# EAGLE schematic Resistor_Resistor (EAGLE 8.3.0), part 30 of 43
## Nets (continued)
N$21: R3001.2 R3002.2 R3003.2 R3004.2 R3005.2 R3006.2 R3007.2 R3008.2 R3009.2 R3010.2 R3011.2 R3012.2 R3013.2 R3014.2 R3015.2 R3016.2 R3017.2 R3018.2 R3019.2 R3020.2 R3021.2 R3022.2 R3023.2 R3024.2 R3025.2 R3026.2 R3027.2 R3028.2 R3029.2 R3030.2 R3031.2 R3032.2 R3033.2 R3034.2 R3035.2 R3036.2 R3037.2 R3038.2 R3039.2 R3040.2 R3041.2 R3042.2 R3043.2 R3044.2 R3045.2 R3046.2 R3047.2 R3048.2 R3049.2 R3050.2 R3051.2 R3052.2 R3053.2 R3054.2 R3055.2 R3056.2 R3057.2 R3058.2 R3059.2 R3060.2 R3061.2 R3062.2 R3063.2 R3064.2 R3065.2 R3066.2 R3067.2 R3068.2 R3069.2 R3070.2 R3071.2 R3072.2 R3073.2 R3074.2 R3075.2 R3076.2 R3077.2 R3078.2 R3079.2 R3080.2 R3081.2 R3082.2 R3083.2 R3084.2 R3085.2 R3086.2 R3087.2 R3088.2 R3089.2 R3090.2 R3091.2 R3092.2 R3093.2 R3094.2 R3095.2 R3096.2 R3097.2 R3098.2 R3099.2 R3100.2 R3101.2 R3102.2 R3103.2 R3104.2 R3105.2 R3106.2 R3107.2 R3108.2 R3109.2 R3110.2 R3111.2 R3112.2 R3113.2 R3114.2 R3115.2 R3116.2 R3117.2 R3118.2 R3119.2 R3120.2 R3121.2 R3122.2 R3123.2 R3124.2 R3125.2 R3126.2 R3127.2 R3128.2 R3129.2 R3130.2 R3131.2 R3132.2 R3133.2 R3134.2 R3135.2 R3136.2 R3137.2 R3138.2 R3139.2 R3140.2 R3141.2 R3142.2 R3143.2 R3144.2 R3145.2 R3146.2 R3147.2 R3148.2 R3149.2 R3150.2 R3151.2 R3152.2 R3153.2 R3154.2 R3155.2 R3156.2 R3157.2 R3158.2 R3159.2 R3160.2 R3161.2 R3162.2 R3163.2 R3164.2 R3165.2 R3166.2 R3167.2 R3168.2 R3169.2 R3170.2 R3171.2 R3172.2 R3173.2 R3174.2 R3175.2 R3176.2 R3177.2 R3178.2 R3179.2 R3180.2 R3181.2 R3182.2 R3183.2 R3184.2 R3185.2 R3186.2 R3187.2 R3188.2 R3189.2 R3190.2 R3191.2 R3192.2 R3193.2 R3194.2 R3195.2 R3196.2 R3197.2 R3198.2 R3199.2 R3200.2 R3201.1 R3202.1 R3203.1 R3204.1 R3205.1 R3206.1 R3207.1 R3208.1 R3209.1 R3210.1 R3211.1 R3212.1 R3213.1 R3214.1 R3215.1 R3216.1 R3217.1 R3218.1 R3219.1 R3220.1 R3221.1 R3222.1 R3223.1 R3224.1 R3225.1 R3226.1 R3227.1 R3228.1 R3229.1 R3230.1 R3231.1 R3232.1 R3233.1 R3234.1 R3235.1 R3236.1 R3237.1 R3238.1 R3239.1 R3240.1 R3241.1 R3242.1 R3243.1 R3244.1 R3245.1 R3246.1 R3247.1 R3248.1 R3249.1 R3250.1 R3251.1 R3252.1 R3253.1 R3254.1 R3255.1 R3256.1 R3257.1 R3258.1 R3259.1 R3260.1 R3261.1 R3262.1 R3263.1 R3264.1 R3265.1 R3266.1 R3267.1 R3268.1 R3269.1 R3270.1 R3271.1 R3272.1 R3273.1 R3274.1 R3275.1 R3276.1 R3277.1 R3278.1 R3279.1 R3280.1 R3281.1 R3282.1 R3283.1 R3284.1 R3285.1 R3286.1 R3287.1 R3288.1 R3289.1 R3290.1 R3291.1 R3292.1 R3293.1 R3294.1 R3295.1 R3296.1 R3297.1 R3298.1 R3299.1 R3300.1 R3301.1 R3302.1 R3303.1 R3304.1 R3305.1 R3306.1 R3307.1 R3308.1 R3309.1 R3310.1 R3311.1 R3312.1 R3313.1 R3314.1 R3315.1 R3316.1 R3317.1 R3318.1 R3319.1 R3320.1 R3321.1 R3322.1 R3323.1 R3324.1 R3325.1 R3326.1 R3327.1 R3328.1 R3329.1 R3330.1 R3331.1 R3332.1 R3333.1 R3334.1 R3335.1 R3336.1 R3337.1 R3338.1 R3339.1 R3340.1 R3341.1 R3342.1 R3343.1 R3344.1 R3345.1 R3346.1 R3347.1 R3348.1 R3349.1 R3350.1 R3351.1 R3352.1 R3353.1 R3354.1 R3355.1 R3356.1 R3357.1 R3358.1 R3359.1 R3360.1 R3361.1 R3362.1 R3363.1 R3364.1 R3365.1 R3366.1 R3367.1 R3368.1 R3369.1 R3370.1 R3371.1 R3372.1 R3373.1 R3374.1 R3375.1 R3376.1 R3377.1 R3378.1 R3379.1 R3380.1 R3381.1 R3382.1 R3383.1 R3384.1 R3385.1 R3386.1 R3387.1 R3388.1 R3389.1 R3390.1 R3391.1 R3392.1 R3393.1 R3394.1 R3395.1 R3396.1 R3397.1 R3398.1 R3399.1 R3400.1
N$23: R3201.2 R3202.2 R3203.2 R3204.2 R3205.2 R3206.2 R3207.2 R3208.2 R3209.2 R3210.2 R3211.2 R3212.2 R3213.2 R3214.2 R3215.2 R3216.2 R3217.2 R3218.2 R3219.2 R3220.2 R3221.2 R3222.2 R3223.2 R3224.2 R3225.2 R3226.2 R3227.2 R3228.2 R3229.2 R3230.2 R3231.2 R3232.2 R3233.2 R3234.2 R3235.2 R3236.2 R3237.2 R3238.2 R3239.2 R3240.2 R3241.2 R3242.2 R3243.2 R3244.2 R3245.2 R3246.2 R3247.2 R3248.2 R3249.2 R3250.2 R3251.2 R3252.2 R3253.2 R3254.2 R3255.2 R3256.2 R3257.2 R3258.2 R3259.2 R3260.2 R3261.2 R3262.2 R3263.2 R3264.2 R3265.2 R3266.2 R3267.2 R3268.2 R3269.2 R3270.2 R3271.2 R3272.2 R3273.2 R3274.2 R3275.2 R3276.2 R3277.2 R3278.2 R3279.2 R3280.2 R3281.2 R3282.2 R3283.2 R3284.2 R3285.2 R3286.2 R3287.2 R3288.2 R3289.2 R3290.2 R3291.2 R3292.2 R3293.2 R3294.2 R3295.2 R3296.2 R3297.2 R3298.2 R3299.2 R3300.2 R3301.2 R3302.2 R3303.2 R3304.2 R3305.2 R3306.2 R3307.2 R3308.2 R3309.2 R3310.2 R3311.2 R3312.2 R3313.2 R3314.2 R3315.2 R3316.2 R3317.2 R3318.2 R3319.2 R3320.2 R3321.2 R3322.2 R3323.2 R3324.2 R3325.2 R3326.2 R3327.2 R3328.2 R3329.2 R3330.2 R3331.2 R3332.2 R3333.2 R3334.2 R3335.2 R3336.2 R3337.2 R3338.2 R3339.2 R3340.2 R3341.2 R3342.2 R3343.2 R3344.2 R3345.2 R3346.2 R3347.2 R3348.2 R3349.2 R3350.2 R3351.2 R3352.2 R3353.2 R3354.2 R3355.2 R3356.2 R3357.2 R3358.2 R3359.2 R3360.2 R3361.2 R3362.2 R3363.2 R3364.2 R3365.2 R3366.2 R3367.2 R3368.2 R3369.2 R3370.2 R3371.2 R3372.2 R3373.2 R3374.2 R3375.2 R3376.2 R3377.2 R3378.2 R3379.2 R3380.2 R3381.2 R3382.2 R3383.2 R3384.2 R3385.2 R3386.2 R3387.2 R3388.2 R3389.2 R3390.2 R3391.2 R3392.2 R3393.2 R3394.2 R3395.2 R3396.2 R3397.2 R3398.2 R3399.2 R3400.2 R3401.1 R3402.1 R3403.1 R3404.1 R3405.1 R3406.1 R3407.1 R3408.1 R3409.1 R3410.1 R3411.1 R3412.1 R3413.1 R3414.1 R3415.1 R3416.1 R3417.1 R3418.1 R3419.1 R3420.1 R3421.1 R3422.1 R3423.1 R3424.1 R3425.1 R3426.1 R3427.1 R3428.1 R3429.1 R3430.1 R3431.1 R3432.1 R3433.1 R3434.1 R3435.1 R3436.1 R3437.1 R3438.1 R3439.1 R3440.1 R3441.1 R3442.1 R3443.1 R3444.1 R3445.1 R3446.1 R3447.1 R3448.1 R3449.1 R3450.1 R3451.1 R3452.1 R3453.1 R3454.1 R3455.1 R3456.1 R3457.1 R3458.1 R3459.1 R3460.1 R3461.1 R3462.1 R3463.1 R3464.1 R3465.1 R3466.1 R3467.1 R3468.1 R3469.1 R3470.1 R3471.1 R3472.1 R3473.1 R3474.1 R3475.1 R3476.1 R3477.1 R3478.1 R3479.1 R3480.1 R3481.1 R3482.1 R3483.1 R3484.1 R3485.1 R3486.1 R3487.1 R3488.1 R3489.1 R3490.1 R3491.1 R3492.1 R3493.1 R3494.1 R3495.1 R3496.1 R3497.1 R3498.1 R3499.1 R3500.1 R3501.1 R3502.1 R3503.1 R3504.1 R3505.1 R3506.1 R3507.1 R3508.1 R3509.1 R3510.1 R3511.1 R3512.1 R3513.1 R3514.1 R3515.1 R3516.1 R3517.1 R3518.1 R3519.1 R3520.1 R3521.1 R3522.1 R3523.1 R3524.1 R3525.1 R3526.1 R3527.1 R3528.1 R3529.1 R3530.1 R3531.1 R3532.1 R3533.1 R3534.1 R3535.1 R3536.1 R3537.1 R3538.1 R3539.1 R3540.1 R3541.1 R3542.1 R3543.1 R3544.1 R3545.1 R3546.1 R3547.1 R3548.1 R3549.1 R3550.1 R3551.1 R3552.1 R3553.1 R3554.1 R3555.1 R3556.1 R3557.1 R3558.1 R3559.1 R3560.1 R3561.1 R3562.1 R3563.1 R3564.1 R3565.1 R3566.1 R3567.1 R3568.1 R3569.1 R3570.1 R3571.1 R3572.1 R3573.1 R3574.1 R3575.1 R3576.1 R3577.1 R3578.1 R3579.1 R3580.1 R3581.1 R3582.1 R3583.1 R3584.1 R3585.1 R3586.1 R3587.1 R3588.1 R3589.1 R3590.1 R3591.1 R3592.1 R3593.1 R3594.1 R3595.1 R3596.1 R3597.1 R3598.1 R3599.1 R3600.1
N$24: R3401.2 R3402.2 R3403.2 R3404.2 R3405.2 R3406.2 R3407.2 R3408.2 R3409.2 R3410.2 R3411.2 R3412.2 R3413.2 R3414.2 R3415.2 R3416.2 R3417.2 R3418.2 R3419.2 R3420.2 R3421.2 R3422.2 R3423.2 R3424.2 R3425.2 R3426.2 R3427.2 R3428.2 R3429.2 R3430.2 R3431.2 R3432.2 R3433.2 R3434.2 R3435.2 R3436.2 R3437.2 R3438.2 R3439.2 R3440.2 R3441.2 R3442.2 R3443.2 R3444.2 R3445.2 R3446.2 R3447.2 R3448.2 R3449.2 R3450.2 R3451.2 R3452.2 R3453.2 R3454.2 R3455.2 R3456.2 R3457.2 R3458.2 R3459.2 R3460.2 R3461.2 R3462.2 R3463.2 R3464.2 R3465.2 R3466.2 R3467.2 R3468.2 R3469.2 R3470.2 R3471.2 R3472.2 R3473.2 R3474.2 R3475.2 R3476.2 R3477.2 R3478.2 R3479.2 R3480.2 R3481.2 R3482.2 R3483.2 R3484.2 R3485.2 R3486.2 R3487.2 R3488.2 R3489.2 R3490.2 R3491.2 R3492.2 R3493.2 R3494.2 R3495.2 R3496.2 R3497.2 R3498.2 R3499.2 R3500.2 R3501.2 R3502.2 R3503.2 R3504.2 R3505.2 R3506.2 R3507.2 R3508.2 R3509.2 R3510.2 R3511.2 R3512.2 R3513.2 R3514.2 R3515.2 R3516.2 R3517.2 R3518.2 R3519.2 R3520.2 R3521.2 R3522.2 R3523.2 R3524.2 R3525.2 R3526.2 R3527.2 R3528.2 R3529.2 R3530.2 R3531.2 R3532.2 R3533.2 R3534.2 R3535.2 R3536.2 R3537.2 R3538.2 R3539.2 R3540.2 R3541.2 R3542.2 R3543.2 R3544.2 R3545.2 R3546.2 R3547.2 R3548.2 R3549.2 R3550.2 R3551.2 R3552.2 R3553.2 R3554.2 R3555.2 R3556.2 R3557.2 R3558.2 R3559.2 R3560.2 R3561.2 R3562.2 R3563.2 R3564.2 R3565.2 R3566.2 R3567.2 R3568.2 R3569.2 R3570.2 R3571.2 R3572.2 R3573.2 R3574.2 R3575.2 R3576.2 R3577.2 R3578.2 R3579.2 R3580.2 R3581.2 R3582.2 R3583.2 R3584.2 R3585.2 R3586.2 R3587.2 R3588.2 R3589.2 R3590.2 R3591.2 R3592.2 R3593.2 R3594.2 R3595.2 R3596.2 R3597.2 R3598.2 R3599.2 R3600.2 R3601.1 R3602.1 R3603.1 R3604.1 R3605.1 R3606.1 R3607.1 R3608.1 R3609.1 R3610.1 R3611.1 R3612.1 R3613.1 R3614.1 R3615.1 R3616.1 R3617.1 R3618.1 R3619.1 R3620.1 R3621.1 R3622.1 R3623.1 R3624.1 R3625.1 R3626.1 R3627.1 R3628.1 R3629.1 R3630.1 R3631.1 R3632.1 R3633.1 R3634.1 R3635.1 R3636.1 R3637.1 R3638.1 R3639.1 R3640.1 R3641.1 R3642.1 R3643.1 R3644.1 R3645.1 R3646.1 R3647.1 R3648.1 R3649.1 R3650.1 R3651.1 R3652.1 R3653.1 R3654.1 R3655.1 R3656.1 R3657.1 R3658.1 R3659.1 R3660.1 R3661.1 R3662.1 R3663.1 R3664.1 R3665.1 R3666.1 R3667.1 R3668.1 R3669.1 R3670.1 R3671.1 R3672.1 R3673.1 R3674.1 R3675.1 R3676.1 R3677.1 R3678.1 R3679.1 R3680.1 R3681.1 R3682.1 R3683.1 R3684.1 R3685.1 R3686.1 R3687.1 R3688.1 R3689.1 R3690.1 R3691.1 R3692.1 R3693.1 R3694.1 R3695.1 R3696.1 R3697.1 R3698.1 R3699.1 R3700.1 R3701.1 R3702.1 R3703.1 R3704.1 R3705.1 R3706.1 R3707.1 R3708.1 R3709.1 R3710.1 R3711.1 R3712.1 R3713.1 R3714.1 R3715.1 R3716.1 R3717.1 R3718.1 R3719.1 R3720.1 R3721.1 R3722.1 R3723.1 R3724.1 R3725.1 R3726.1 R3727.1 R3728.1 R3729.1 R3730.1 R3731.1 R3732.1 R3733.1 R3734.1 R3735.1 R3736.1 R3737.1 R3738.1 R3739.1 R3740.1 R3741.1 R3742.1 R3743.1 R3744.1 R3745.1 R3746.1 R3747.1 R3748.1 R3749.1 R3750.1 R3751.1 R3752.1 R3753.1 R3754.1 R3755.1 R3756.1 R3757.1 R3758.1 R3759.1 R3760.1 R3761.1 R3762.1 R3763.1 R3764.1 R3765.1 R3766.1 R3767.1 R3768.1 R3769.1 R3770.1 R3771.1 R3772.1 R3773.1 R3774.1 R3775.1 R3776.1 R3777.1 R3778.1 R3779.1 R3780.1 R3781.1 R3782.1 R3783.1 R3784.1 R3785.1 R3786.1 R3787.1 R3788.1 R3789.1 R3790.1 R3791.1 R3792.1 R3793.1 R3794.1 R3795.1 R3796.1 R3797.1 R3798.1 R3799.1 R3800.1
N$25: R3601.2 R3602.2 R3603.2 R3604.2 R3605.2 R3606.2 R3607.2 R3608.2 R3609.2 R3610.2 R3611.2 R3612.2 R3613.2 R3614.2 R3615.2 R3616.2 R3617.2 R3618.2 R3619.2 R3620.2 R3621.2 R3622.2 R3623.2 R3624.2 R3625.2 R3626.2 R3627.2 R3628.2 R3629.2 R3630.2 R3631.2 R3632.2 R3633.2 R3634.2 R3635.2 R3636.2 R3637.2 R3638.2 R3639.2 R3640.2 R3641.2 R3642.2 R3643.2 R3644.2 R3645.2 R3646.2 R3647.2 R3648.2 R3649.2 R3650.2 R3651.2 R3652.2 R3653.2 R3654.2 R3655.2 R3656.2 R3657.2 R3658.2 R3659.2 R3660.2 R3661.2 R3662.2 R3663.2 R3664.2 R3665.2 R3666.2 R3667.2 R3668.2 R3669.2 R3670.2 R3671.2 R3672.2 R3673.2 R3674.2 R3675.2 R3676.2 R3677.2 R3678.2 R3679.2 R3680.2 R3681.2 R3682.2 R3683.2 R3684.2 R3685.2 R3686.2 R3687.2 R3688.2 R3689.2 R3690.2 R3691.2 R3692.2 R3693.2 R3694.2 R3695.2 R3696.2 R3697.2 R3698.2 R3699.2 R3700.2 R3701.2 R3702.2 R3703.2 R3704.2 R3705.2 R3706.2 R3707.2 R3708.2 R3709.2 R3710.2 R3711.2 R3712.2 R3713.2 R3714.2 R3715.2 R3716.2 R3717.2 R3718.2 R3719.2 R3720.2 R3721.2 R3722.2 R3723.2 R3724.2 R3725.2 R3726.2 R3727.2 R3728.2 R3729.2 R3730.2 R3731.2 R3732.2 R3733.2 R3734.2 R3735.2 R3736.2 R3737.2 R3738.2 R3739.2 R3740.2 R3741.2 R3742.2 R3743.2 R3744.2 R3745.2 R3746.2 R3747.2 R3748.2 R3749.2 R3750.2 R3751.2 R3752.2 R3753.2 R3754.2 R3755.2 R3756.2 R3757.2 R3758.2 R3759.2 R3760.2 R3761.2 R3762.2 R3763.2 R3764.2 R3765.2 R3766.2 R3767.2 R3768.2 R3769.2 R3770.2 R3771.2 R3772.2 R3773.2 R3774.2 R3775.2 R3776.2 R3777.2 R3778.2 R3779.2 R3780.2 R3781.2 R3782.2 R3783.2 R3784.2 R3785.2 R3786.2 R3787.2 R3788.2 R3789.2 R3790.2 R3791.2 R3792.2 R3793.2 R3794.2 R3795.2 R3796.2 R3797.2 R3798.2 R3799.2 R3800.2 R3801.1 R3802.1 R3803.1 R3804.1 R3805.1 R3806.1 R3807.1 R3808.1 R3809.1 R3810.1 R3811.1 R3812.1 R3813.1 R3814.1 R3815.1 R3816.1 R3817.1 R3818.1 R3819.1 R3820.1 R3821.1 R3822.1 R3823.1 R3824.1 R3825.1 R3826.1 R3827.1 R3828.1 R3829.1 R3830.1 R3831.1 R3832.1 R3833.1 R3834.1 R3835.1 R3836.1 R3837.1 R3838.1 R3839.1 R3840.1 R3841.1 R3842.1 R3843.1 R3844.1 R3845.1 R3846.1 R3847.1 R3848.1 R3849.1 R3850.1 R3851.1 R3852.1 R3853.1 R3854.1 R3855.1 R3856.1 R3857.1 R3858.1 R3859.1 R3860.1 R3861.1 R3862.1 R3863.1 R3864.1 R3865.1 R3866.1 R3867.1 R3868.1 R3869.1 R3870.1 R3871.1 R3872.1 R3873.1 R3874.1 R3875.1 R3876.1 R3877.1 R3878.1 R3879.1 R3880.1 R3881.1 R3882.1 R3883.1 R3884.1 R3885.1 R3886.1 R3887.1 R3888.1 R3889.1 R3890.1 R3891.1 R3892.1 R3893.1 R3894.1 R3895.1 R3896.1 R3897.1 R3898.1 R3899.1 R3900.1 R3901.1 R3902.1 R3903.1 R3904.1 R3905.1 R3906.1 R3907.1 R3908.1 R3909.1 R3910.1 R3911.1 R3912.1 R3913.1 R3914.1 R3915.1 R3916.1 R3917.1 R3918.1 R3919.1 R3920.1 R3921.1 R3922.1 R3923.1 R3924.1 R3925.1 R3926.1 R3927.1 R3928.1 R3929.1 R3930.1 R3931.1 R3932.1 R3933.1 R3934.1 R3935.1 R3936.1 R3937.1 R3938.1 R3939.1 R3940.1 R3941.1 R3942.1 R3943.1 R3944.1 R3945.1 R3946.1 R3947.1 R3948.1 R3949.1 R3950.1 R3951.1 R3952.1 R3953.1 R3954.1 R3955.1 R3956.1 R3957.1 R3958.1 R3959.1 R3960.1 R3961.1 R3962.1 R3963.1 R3964.1 R3965.1 R3966.1 R3967.1 R3968.1 R3969.1 R3970.1 R3971.1 R3972.1 R3973.1 R3974.1 R3975.1 R3976.1 R3977.1 R3978.1 R3979.1 R3980.1 R3981.1 R3982.1 R3983.1 R3984.1 R3985.1 R3986.1 R3987.1 R3988.1 R3989.1 R3990.1 R3991.1 R3992.1 R3993.1 R3994.1 R3995.1 R3996.1 R3997.1 R3998.1 R3999.1 R4000.1
N$26: R3801.2 R3802.2 R3803.2 R3804.2 R3805.2 R3806.2 R3807.2 R3808.2 R3809.2 R3810.2 R3811.2 R3812.2 R3813.2 R3814.2 R3815.2 R3816.2 R3817.2 R3818.2 R3819.2 R3820.2 R3821.2 R3822.2 R3823.2 R3824.2 R3825.2 R3826.2 R3827.2 R3828.2 R3829.2 R3830.2 R3831.2 R3832.2 R3833.2 R3834.2 R3835.2 R3836.2 R3837.2 R3838.2 R3839.2 R3840.2 R3841.2 R3842.2 R3843.2 R3844.2 R3845.2 R3846.2 R3847.2 R3848.2 R3849.2 R3850.2 R3851.2 R3852.2 R3853.2 R3854.2 R3855.2 R3856.2 R3857.2 R3858.2 R3859.2 R3860.2 R3861.2 R3862.2 R3863.2 R3864.2 R3865.2 R3866.2 R3867.2 R3868.2 R3869.2 R3870.2 R3871.2 R3872.2 R3873.2 R3874.2 R3875.2 R3876.2 R3877.2 R3878.2 R3879.2 R3880.2 R3881.2 R3882.2 R3883.2 R3884.2 R3885.2 R3886.2 R3887.2 R3888.2 R3889.2 R3890.2 R3891.2 R3892.2 R3893.2 R3894.2 R3895.2 R3896.2 R3897.2 R3898.2 R3899.2 R3900.2 R3901.2 R3902.2 R3903.2 R3904.2 R3905.2 R3906.2 R3907.2 R3908.2 R3909.2 R3910.2 R3911.2 R3912.2 R3913.2 R3914.2 R3915.2 R3916.2 R3917.2 R3918.2 R3919.2 R3920.2 R3921.2 R3922.2 R3923.2 R3924.2 R3925.2 R3926.2 R3927.2 R3928.2 R3929.2 R3930.2 R3931.2 R3932.2 R3933.2 R3934.2 R3935.2 R3936.2 R3937.2 R3938.2 R3939.2 R3940.2 R3941.2 R3942.2 R3943.2 R3944.2 R3945.2 R3946.2 R3947.2 R3948.2 R3949.2 R3950.2 R3951.2 R3952.2 R3953.2 R3954.2 R3955.2 R3956.2 R3957.2 R3958.2 R3959.2 R3960.2 R3961.2 R3962.2 R3963.2 R3964.2 R3965.2 R3966.2 R3967.2 R3968.2 R3969.2 R3970.2 R3971.2 R3972.2 R3973.2 R3974.2 R3975.2 R3976.2 R3977.2 R3978.2 R3979.2 R3980.2 R3981.2 R3982.2 R3983.2 R3984.2 R3985.2 R3986.2 R3987.2 R3988.2 R3989.2 R3990.2 R3991.2 R3992.2 R3993.2 R3994.2 R3995.2 R3996.2 R3997.2 R3998.2 R3999.2 R4000.2 R4001.1 R4002.1 R4003.1 R4004.1 R4005.1 R4006.1 R4007.1 R4008.1 R4009.1 R4010.1 R4011.1 R4012.1 R4013.1 R4014.1 R4015.1 R4016.1 R4017.1 R4018.1 R4019.1 R4020.1 R4021.1 R4022.1 R4023.1 R4024.1 R4025.1 R4026.1 R4027.1 R4028.1 R4029.1 R4030.1 R4031.1 R4032.1 R4033.1 R4034.1 R4035.1 R4036.1 R4037.1 R4038.1 R4039.1 R4040.1 R4041.1 R4042.1 R4043.1 R4044.1 R4045.1 R4046.1 R4047.1 R4048.1 R4049.1 R4050.1 R4051.1 R4052.1 R4053.1 R4054.1 R4055.1 R4056.1 R4057.1 R4058.1 R4059.1 R4060.1 R4061.1 R4062.1 R4063.1 R4064.1 R4065.1 R4066.1 R4067.1 R4068.1 R4069.1 R4070.1 R4071.1 R4072.1 R4073.1 R4074.1 R4075.1 R4076.1 R4077.1 R4078.1 R4079.1 R4080.1 R4081.1 R4082.1 R4083.1 R4084.1 R4085.1 R4086.1 R4087.1 R4088.1 R4089.1 R4090.1 R4091.1 R4092.1 R4093.1 R4094.1 R4095.1 R4096.1 R4097.1 R4098.1 R4099.1 R4100.1 R4101.1 R4102.1 R4103.1 R4104.1 R4105.1 R4106.1 R4107.1 R4108.1 R4109.1 R4110.1 R4111.1 R4112.1 R4113.1 R4114.1 R4115.1 R4116.1 R4117.1 R4118.1 R4119.1 R4120.1 R4121.1 R4122.1 R4123.1 R4124.1 R4125.1 R4126.1 R4127.1 R4128.1 R4129.1 R4130.1 R4131.1 R4132.1 R4133.1 R4134.1 R4135.1 R4136.1 R4137.1 R4138.1 R4139.1 R4140.1 R4141.1 R4142.1 R4143.1 R4144.1 R4145.1 R4146.1 R4147.1 R4148.1 R4149.1 R4150.1 R4151.1 R4152.1 R4153.1 R4154.1 R4155.1 R4156.1 R4157.1 R4158.1 R4159.1 R4160.1 R4161.1 R4162.1 R4163.1 R4164.1 R4165.1 R4166.1 R4167.1 R4168.1 R4169.1 R4170.1 R4171.1 R4172.1 R4173.1 R4174.1 R4175.1 R4176.1 R4177.1 R4178.1 R4179.1 R4180.1 R4181.1 R4182.1 R4183.1 R4184.1 R4185.1 R4186.1 R4187.1 R4188.1 R4189.1 R4190.1 R4191.1 R4192.1 R4193.1 R4194.1 R4195.1 R4196.1 R4197.1 R4198.1 R4199.1 R4200.1
N$27: R4001.2 R4002.2 R4003.2 R4004.2 R4005.2 R4006.2 R4007.2 R4008.2 R4009.2 R4010.2 R4011.2 R4012.2 R4013.2 R4014.2 R4015.2 R4016.2 R4017.2 R4018.2 R4019.2 R4020.2 R4021.2 R4022.2 R4023.2 R4024.2 R4025.2 R4026.2 R4027.2 R4028.2 R4029.2 R4030.2 R4031.2 R4032.2 R4033.2 R4034.2 R4035.2 R4036.2 R4037.2 R4038.2 R4039.2 R4040.2 R4041.2 R4042.2 R4043.2 R4044.2 R4045.2 R4046.2 R4047.2 R4048.2 R4049.2 R4050.2 R4051.2 R4052.2 R4053.2 R4054.2 R4055.2 R4056.2 R4057.2 R4058.2 R4059.2 R4060.2 R4061.2 R4062.2 R4063.2 R4064.2 R4065.2 R4066.2 R4067.2 R4068.2 R4069.2 R4070.2 R4071.2 R4072.2 R4073.2 R4074.2 R4075.2 R4076.2 R4077.2 R4078.2 R4079.2 R4080.2 R4081.2 R4082.2 R4083.2 R4084.2 R4085.2 R4086.2 R4087.2 R4088.2 R4089.2 R4090.2 R4091.2 R4092.2 R4093.2 R4094.2 R4095.2 R4096.2 R4097.2 R4098.2 R4099.2 R4100.2 R4101.2 R4102.2 R4103.2 R4104.2 R4105.2 R4106.2 R4107.2 R4108.2 R4109.2 R4110.2 R4111.2 R4112.2 R4113.2 R4114.2 R4115.2 R4116.2 R4117.2 R4118.2 R4119.2 R4120.2 R4121.2 R4122.2 R4123.2 R4124.2 R4125.2 R4126.2 R4127.2 R4128.2 R4129.2 R4130.2 R4131.2 R4132.2 R4133.2 R4134.2 R4135.2 R4136.2 R4137.2 R4138.2 R4139.2 R4140.2 R4141.2 R4142.2 R4143.2 R4144.2 R4145.2 R4146.2 R4147.2 R4148.2 R4149.2 R4150.2 R4151.2 R4152.2 R4153.2 R4154.2 R4155.2 R4156.2 R4157.2 R4158.2 R4159.2 R4160.2 R4161.2 R4162.2 R4163.2 R4164.2 R4165.2 R4166.2 R4167.2 R4168.2 R4169.2 R4170.2 R4171.2 R4172.2 R4173.2 R4174.2 R4175.2 R4176.2 R4177.2 R4178.2 R4179.2 R4180.2 R4181.2 R4182.2 R4183.2 R4184.2 R4185.2 R4186.2 R4187.2 R4188.2 R4189.2 R4190.2 R4191.2 R4192.2 R4193.2 R4194.2 R4195.2 R4196.2 R4197.2 R4198.2 R4199.2 R4200.2 R4201.1 R4202.1 R4203.1 R4204.1 R4205.1 R4206.1 R4207.1 R4208.1 R4209.1 R4210.1 R4211.1 R4212.1 R4213.1 R4214.1 R4215.1 R4216.1 R4217.1 R4218.1 R4219.1 R4220.1 R4221.1 R4222.1 R4223.1 R4224.1 R4225.1 R4226.1 R4227.1 R4228.1 R4229.1 R4230.1 R4231.1 R4232.1 R4233.1 R4234.1 R4235.1 R4236.1 R4237.1 R4238.1 R4239.1 R4240.1 R4241.1 R4242.1 R4243.1 R4244.1 R4245.1 R4246.1 R4247.1 R4248.1 R4249.1 R4250.1 R4251.1 R4252.1 R4253.1 R4254.1 R4255.1 R4256.1 R4257.1 R4258.1 R4259.1 R4260.1 R4261.1 R4262.1 R4263.1 R4264.1 R4265.1 R4266.1 R4267.1 R4268.1 R4269.1 R4270.1 R4271.1 R4272.1 R4273.1 R4274.1 R4275.1 R4276.1 R4277.1 R4278.1 R4279.1 R4280.1 R4281.1 R4282.1 R4283.1 R4284.1 R4285.1 R4286.1 R4287.1 R4288.1 R4289.1 R4290.1 R4291.1 R4292.1 R4293.1 R4294.1 R4295.1 R4296.1 R4297.1 R4298.1 R4299.1 R4300.1 R4301.1 R4302.1 R4303.1 R4304.1 R4305.1 R4306.1 R4307.1 R4308.1 R4309.1 R4310.1 R4311.1 R4312.1 R4313.1 R4314.1 R4315.1 R4316.1 R4317.1 R4318.1 R4319.1 R4320.1 R4321.1 R4322.1 R4323.1 R4324.1 R4325.1 R4326.1 R4327.1 R4328.1 R4329.1 R4330.1 R4331.1 R4332.1 R4333.1 R4334.1 R4335.1 R4336.1 R4337.1 R4338.1 R4339.1 R4340.1 R4341.1 R4342.1 R4343.1 R4344.1 R4345.1 R4346.1 R4347.1 R4348.1 R4349.1 R4350.1 R4351.1 R4352.1 R4353.1 R4354.1 R4355.1 R4356.1 R4357.1 R4358.1 R4359.1 R4360.1 R4361.1 R4362.1 R4363.1 R4364.1 R4365.1 R4366.1 R4367.1 R4368.1 R4369.1 R4370.1 R4371.1 R4372.1 R4373.1 R4374.1 R4375.1 R4376.1 R4377.1 R4378.1 R4379.1 R4380.1 R4381.1 R4382.1 R4383.1 R4384.1 R4385.1 R4386.1 R4387.1 R4388.1 R4389.1 R4390.1 R4391.1 R4392.1 R4393.1 R4394.1 R4395.1 R4396.1 R4397.1 R4398.1 R4399.1 R4400.1
N$28: R4201.2 R4202.2 R4203.2 R4204.2 R4205.2 R4206.2 R4207.2 R4208.2 R4209.2 R4210.2 R4211.2 R4212.2 R4213.2 R4214.2 R4215.2 R4216.2 R4217.2 R4218.2 R4219.2 R4220.2 R4221.2 R4222.2 R4223.2 R4224.2 R4225.2 R4226.2 R4227.2 R4228.2 R4229.2 R4230.2 R4231.2 R4232.2 R4233.2 R4234.2 R4235.2 R4236.2 R4237.2 R4238.2 R4239.2 R4240.2 R4241.2 R4242.2 R4243.2 R4244.2 R4245.2 R4246.2 R4247.2 R4248.2 R4249.2 R4250.2 R4251.2 R4252.2 R4253.2 R4254.2 R4255.2 R4256.2 R4257.2 R4258.2 R4259.2 R4260.2 R4261.2 R4262.2 R4263.2 R4264.2 R4265.2 R4266.2 R4267.2 R4268.2 R4269.2 R4270.2 R4271.2 R4272.2 R4273.2 R4274.2 R4275.2 R4276.2 R4277.2 R4278.2 R4279.2 R4280.2 R4281.2 R4282.2 R4283.2 R4284.2 R4285.2 R4286.2 R4287.2 R4288.2 R4289.2 R4290.2 R4291.2 R4292.2 R4293.2 R4294.2 R4295.2 R4296.2 R4297.2 R4298.2 R4299.2 R4300.2 R4301.2 R4302.2 R4303.2 R4304.2 R4305.2 R4306.2 R4307.2 R4308.2 R4309.2 R4310.2 R4311.2 R4312.2 R4313.2 R4314.2 R4315.2 R4316.2 R4317.2 R4318.2 R4319.2 R4320.2 R4321.2 R4322.2 R4323.2 R4324.2 R4325.2 R4326.2 R4327.2 R4328.2 R4329.2 R4330.2 R4331.2 R4332.2 R4333.2 R4334.2 R4335.2 R4336.2 R4337.2 R4338.2 R4339.2 R4340.2 R4341.2 R4342.2 R4343.2 R4344.2 R4345.2 R4346.2 R4347.2 R4348.2 R4349.2 R4350.2 R4351.2 R4352.2 R4353.2 R4354.2 R4355.2 R4356.2 R4357.2 R4358.2 R4359.2 R4360.2 R4361.2 R4362.2 R4363.2 R4364.2 R4365.2 R4366.2 R4367.2 R4368.2 R4369.2 R4370.2 R4371.2 R4372.2 R4373.2 R4374.2 R4375.2 R4376.2 R4377.2 R4378.2 R4379.2 R4380.2 R4381.2 R4382.2 R4383.2 R4384.2 R4385.2 R4386.2 R4387.2 R4388.2 R4389.2 R4390.2 R4391.2 R4392.2 R4393.2 R4394.2 R4395.2 R4396.2 R4397.2 R4398.2 R4399.2 R4400.2 R4401.1 R4402.1 R4403.1 R4404.1 R4405.1 R4406.1 R4407.1 R4408.1 R4409.1 R4410.1 R4411.1 R4412.1 R4413.1 R4414.1 R4415.1 R4416.1 R4417.1 R4418.1 R4419.1 R4420.1 R4421.1 R4422.1 R4423.1 R4424.1 R4425.1 R4426.1 R4427.1 R4428.1 R4429.1 R4430.1 R4431.1 R4432.1 R4433.1 R4434.1 R4435.1 R4436.1 R4437.1 R4438.1 R4439.1 R4440.1 R4441.1 R4442.1 R4443.1 R4444.1 R4445.1 R4446.1 R4447.1 R4448.1 R4449.1 R4450.1 R4451.1 R4452.1 R4453.1 R4454.1 R4455.1 R4456.1 R4457.1 R4458.1 R4459.1 R4460.1 R4461.1 R4462.1 R4463.1 R4464.1 R4465.1 R4466.1 R4467.1 R4468.1 R4469.1 R4470.1 R4471.1 R4472.1 R4473.1 R4474.1 R4475.1 R4476.1 R4477.1 R4478.1 R4479.1 R4480.1 R4481.1 R4482.1 R4483.1 R4484.1 R4485.1 R4486.1 R4487.1 R4488.1 R4489.1 R4490.1 R4491.1 R4492.1 R4493.1 R4494.1 R4495.1 R4496.1 R4497.1 R4498.1 R4499.1 R4500.1 R4501.1 R4502.1 R4503.1 R4504.1 R4505.1 R4506.1 R4507.1 R4508.1 R4509.1 R4510.1 R4511.1 R4512.1 R4513.1 R4514.1 R4515.1 R4516.1 R4517.1 R4518.1 R4519.1 R4520.1 R4521.1 R4522.1 R4523.1 R4524.1 R4525.1 R4526.1 R4527.1 R4528.1 R4529.1 R4530.1 R4531.1 R4532.1 R4533.1 R4534.1 R4535.1 R4536.1 R4537.1 R4538.1 R4539.1 R4540.1 R4541.1 R4542.1 R4543.1 R4544.1 R4545.1 R4546.1 R4547.1 R4548.1 R4549.1 R4550.1 R4551.1 R4552.1 R4553.1 R4554.1 R4555.1 R4556.1 R4557.1 R4558.1 R4559.1 R4560.1 R4561.1 R4562.1 R4563.1 R4564.1 R4565.1 R4566.1 R4567.1 R4568.1 R4569.1 R4570.1 R4571.1 R4572.1 R4573.1 R4574.1 R4575.1 R4576.1 R4577.1 R4578.1 R4579.1 R4580.1 R4581.1 R4582.1 R4583.1 R4584.1 R4585.1 R4586.1 R4587.1 R4588.1 R4589.1 R4590.1 R4591.1 R4592.1 R4593.1 R4594.1 R4595.1 R4596.1 R4597.1 R4598.1 R4599.1 R4600.1
N$29: R4401.2 R4402.2 R4403.2 R4404.2 R4405.2 R4406.2 R4407.2 R4408.2 R4409.2 R4410.2 R4411.2 R4412.2 R4413.2 R4414.2 R4415.2 R4416.2 R4417.2 R4418.2 R4419.2 R4420.2 R4421.2 R4422.2 R4423.2 R4424.2 R4425.2 R4426.2 R4427.2 R4428.2 R4429.2 R4430.2 R4431.2 R4432.2 R4433.2 R4434.2 R4435.2 R4436.2 R4437.2 R4438.2 R4439.2 R4440.2 R4441.2 R4442.2 R4443.2 R4444.2 R4445.2 R4446.2 R4447.2 R4448.2 R4449.2 R4450.2 R4451.2 R4452.2 R4453.2 R4454.2 R4455.2 R4456.2 R4457.2 R4458.2 R4459.2 R4460.2 R4461.2 R4462.2 R4463.2 R4464.2 R4465.2 R4466.2 R4467.2 R4468.2 R4469.2 R4470.2 R4471.2 R4472.2 R4473.2 R4474.2 R4475.2 R4476.2 R4477.2 R4478.2 R4479.2 R4480.2 R4481.2 R4482.2 R4483.2 R4484.2 R4485.2 R4486.2 R4487.2 R4488.2 R4489.2 R4490.2 R4491.2 R4492.2 R4493.2 R4494.2 R4495.2 R4496.2 R4497.2 R4498.2 R4499.2 R4500.2 R4501.2 R4502.2 R4503.2 R4504.2 R4505.2 R4506.2 R4507.2 R4508.2 R4509.2 R4510.2 R4511.2 R4512.2 R4513.2 R4514.2 R4515.2 R4516.2 R4517.2 R4518.2 R4519.2 R4520.2 R4521.2 R4522.2 R4523.2 R4524.2 R4525.2 R4526.2 R4527.2 R4528.2 R4529.2 R4530.2 R4531.2 R4532.2 R4533.2 R4534.2 R4535.2 R4536.2 R4537.2 R4538.2 R4539.2 R4540.2 R4541.2 R4542.2 R4543.2 R4544.2 R4545.2 R4546.2 R4547.2 R4548.2 R4549.2 R4550.2 R4551.2 R4552.2 R4553.2 R4554.2 R4555.2 R4556.2 R4557.2 R4558.2 R4559.2 R4560.2 R4561.2 R4562.2 R4563.2 R4564.2 R4565.2 R4566.2 R4567.2 R4568.2 R4569.2 R4570.2 R4571.2 R4572.2 R4573.2 R4574.2 R4575.2 R4576.2 R4577.2 R4578.2 R4579.2 R4580.2 R4581.2 R4582.2 R4583.2 R4584.2 R4585.2 R4586.2 R4587.2 R4588.2 R4589.2 R4590.2 R4591.2 R4592.2 R4593.2 R4594.2 R4595.2 R4596.2 R4597.2 R4598.2 R4599.2 R4600.2 R4601.1 R4602.1 R4603.1 R4604.1 R4605.1 R4606.1 R4607.1 R4608.1 R4609.1 R4610.1 R4611.1 R4612.1 R4613.1 R4614.1 R4615.1 R4616.1 R4617.1 R4618.1 R4619.1 R4620.1 R4621.1 R4622.1 R4623.1 R4624.1 R4625.1 R4626.1 R4627.1 R4628.1 R4629.1 R4630.1 R4631.1 R4632.1 R4633.1 R4634.1 R4635.1 R4636.1 R4637.1 R4638.1 R4639.1 R4640.1 R4641.1 R4642.1 R4643.1 R4644.1 R4645.1 R4646.1 R4647.1 R4648.1 R4649.1 R4650.1 R4651.1 R4652.1 R4653.1 R4654.1 R4655.1 R4656.1 R4657.1 R4658.1 R4659.1 R4660.1 R4661.1 R4662.1 R4663.1 R4664.1 R4665.1 R4666.1 R4667.1 R4668.1 R4669.1 R4670.1 R4671.1 R4672.1 R4673.1 R4674.1 R4675.1 R4676.1 R4677.1 R4678.1 R4679.1 R4680.1 R4681.1 R4682.1 R4683.1 R4684.1 R4685.1 R4686.1 R4687.1 R4688.1 R4689.1 R4690.1 R4691.1 R4692.1 R4693.1 R4694.1 R4695.1 R4696.1 R4697.1 R4698.1 R4699.1 R4700.1 R4701.1 R4702.1 R4703.1 R4704.1 R4705.1 R4706.1 R4707.1 R4708.1 R4709.1 R4710.1 R4711.1 R4712.1 R4713.1 R4714.1 R4715.1 R4716.1 R4717.1 R4718.1 R4719.1 R4720.1 R4721.1 R4722.1 R4723.1 R4724.1 R4725.1 R4726.1 R4727.1 R4728.1 R4729.1 R4730.1 R4731.1 R4732.1 R4733.1 R4734.1 R4735.1 R4736.1 R4737.1 R4738.1 R4739.1 R4740.1 R4741.1 R4742.1 R4743.1 R4744.1 R4745.1 R4746.1 R4747.1 R4748.1 R4749.1 R4750.1 R4751.1 R4752.1 R4753.1 R4754.1 R4755.1 R4756.1 R4757.1 R4758.1 R4759.1 R4760.1 R4761.1 R4762.1 R4763.1 R4764.1 R4765.1 R4766.1 R4767.1 R4768.1 R4769.1 R4770.1 R4771.1 R4772.1 R4773.1 R4774.1 R4775.1 R4776.1 R4777.1 R4778.1 R4779.1 R4780.1 R4781.1 R4782.1 R4783.1 R4784.1 R4785.1 R4786.1 R4787.1 R4788.1 R4789.1 R4790.1 R4791.1 R4792.1 R4793.1 R4794.1 R4795.1 R4796.1 R4797.1 R4798.1 R4799.1 R4800.1